# EasyEDA Pro project ProProject_Avaota Pi A_2024-03-25.epro, board PCB1 (continued)
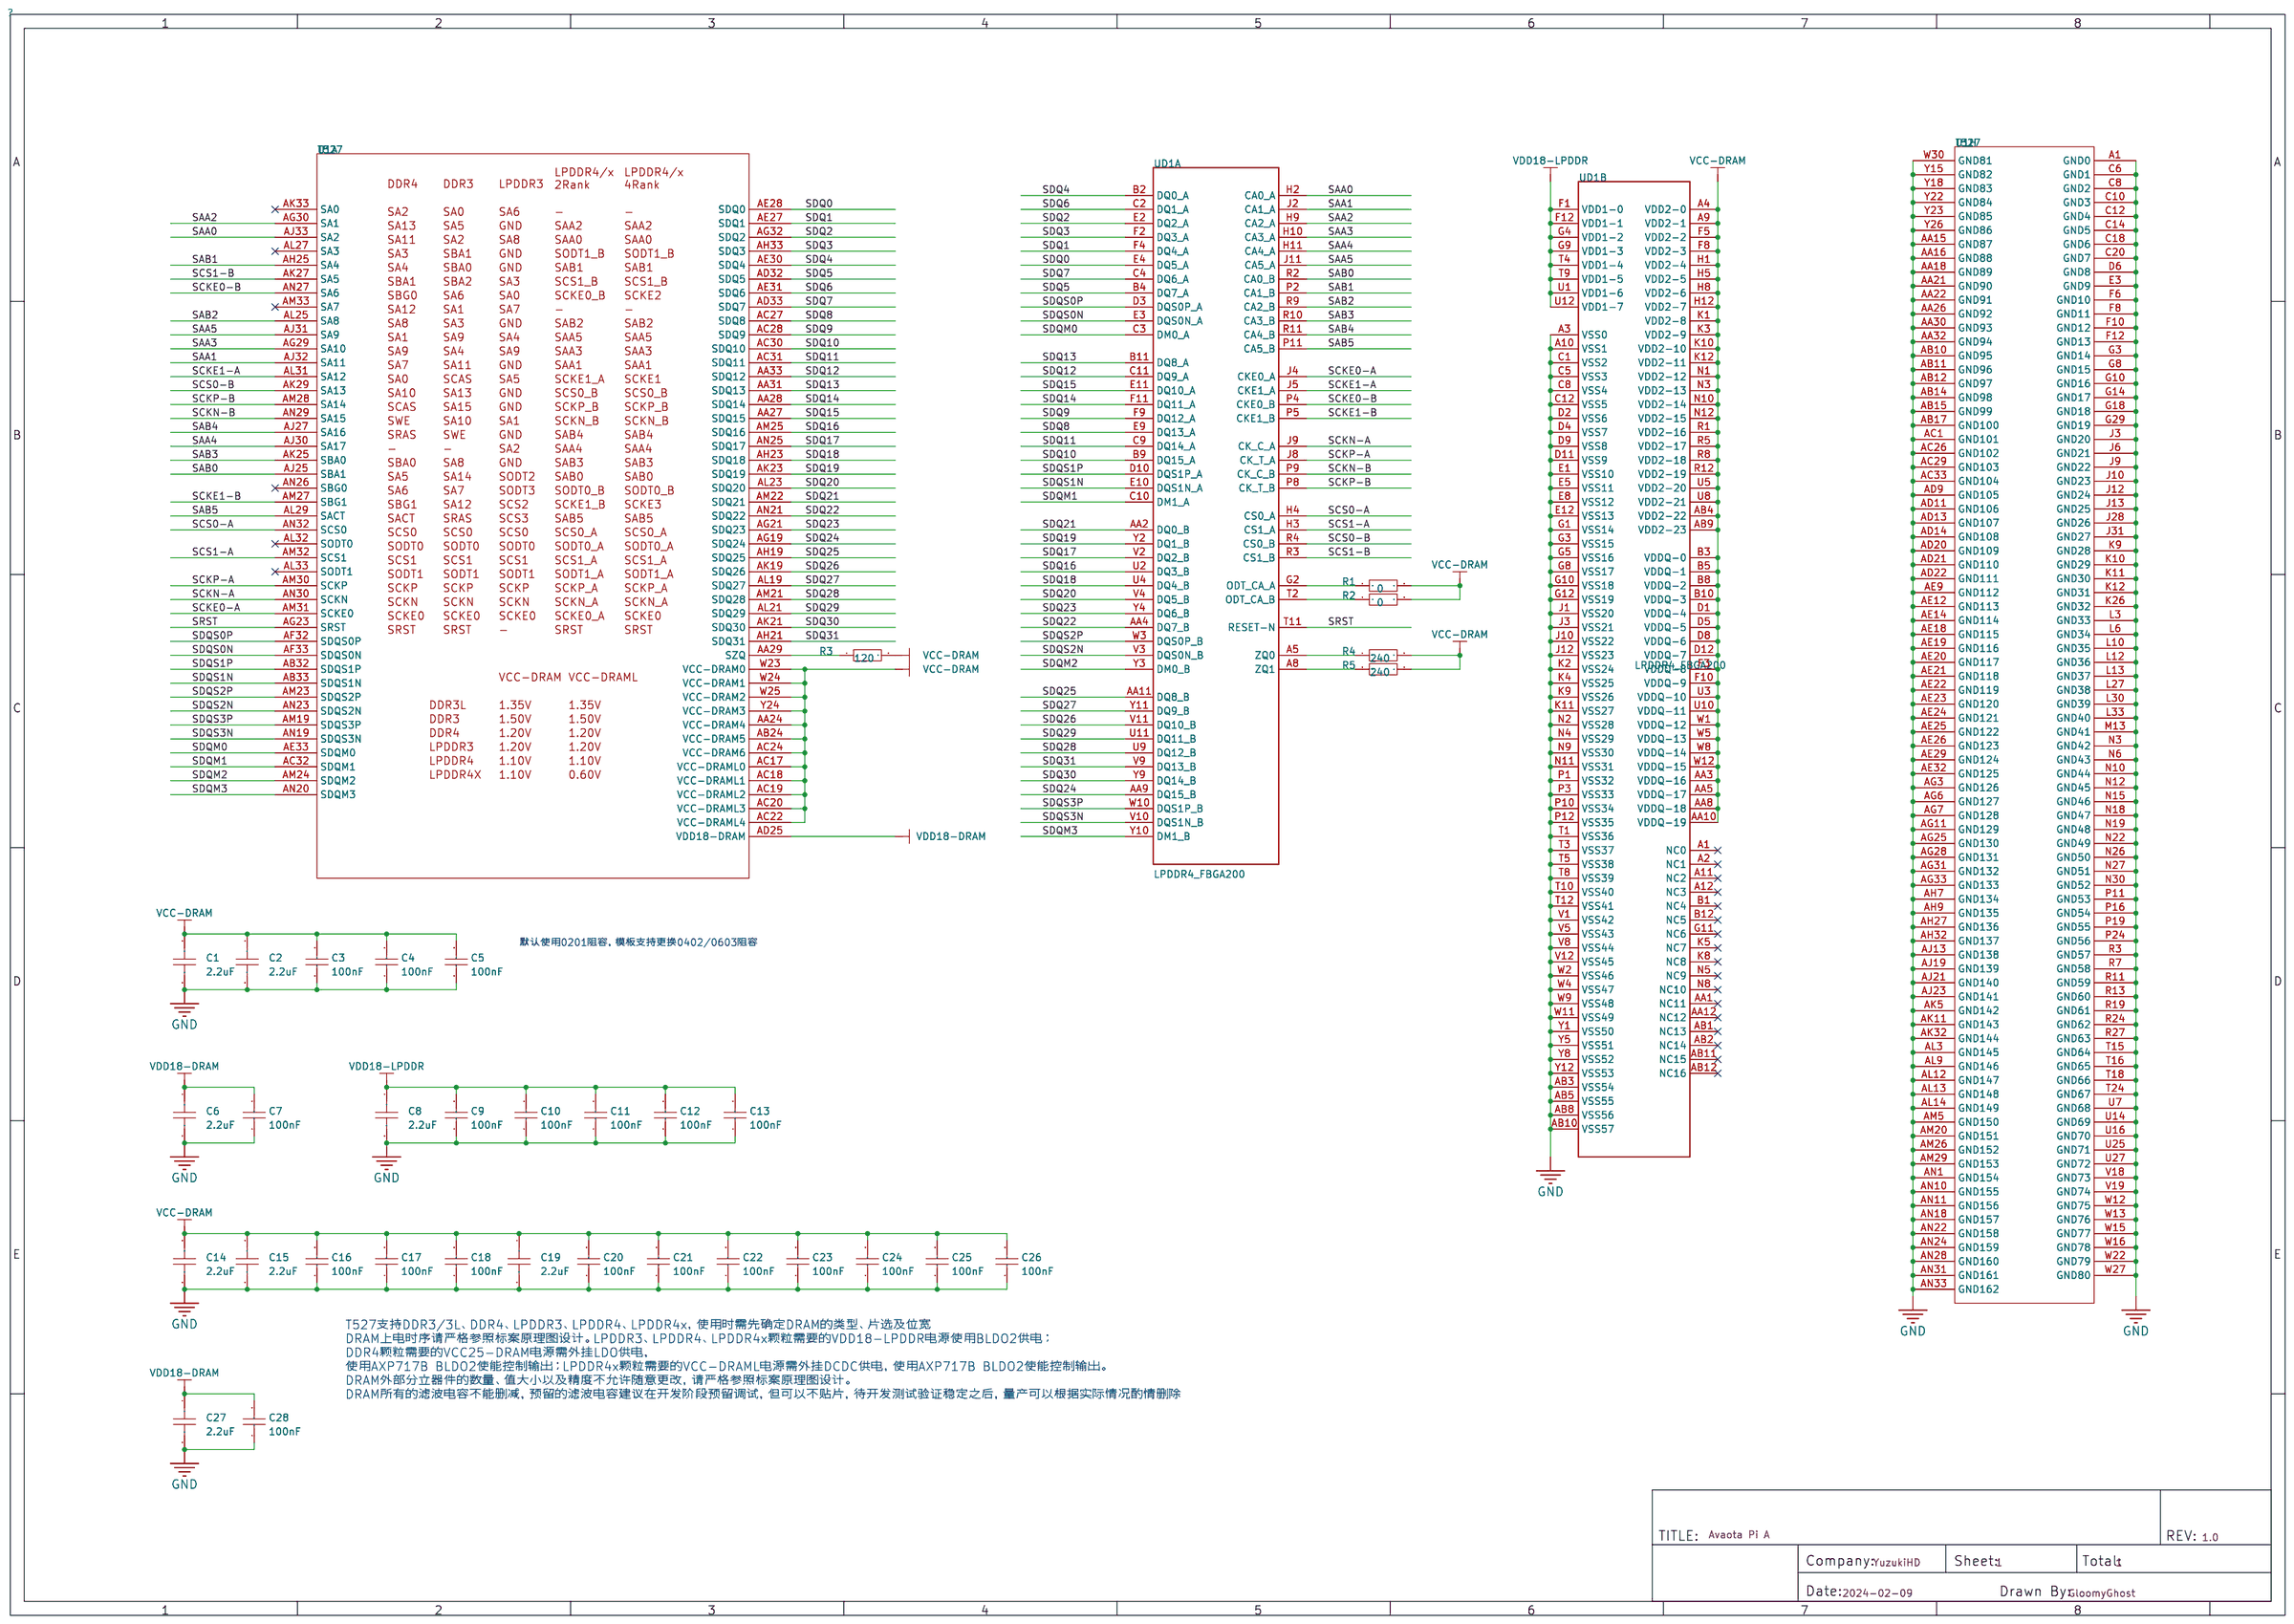
[diagram p0: schematic sheet]
## Routing (per net, layer and track width the routed paths; a pad name or vN(x,y) marks a point on that pad's centre or on a via; arc(x,y) is an arc through that point) (continued)
GM0_MDIP0: length 8.5
  Top Layer w0.127: U12.1 64.8,19.47 64.88,19.38 64.88,18.71 62.59,16.41 62.59,14.59 63.06,14.11 63.06,13.23 RJ1.P2
GM0_MDIP1: length 14.3
  Top Layer w0.127: U12.4 66,19.47 66.08,19.38 66.08,17.34 65.18,16.43 65.18,14.54 66.32,13.39 66.32,12.27 67.06,11.53 67.06,10.97 66.57,10.49 65.63,10.49 65.23,10.9 65.23,12.75 RJ1.P4
GM0_MDIP2: length 7.8
  Top Layer w0.127: RJ1.P5 66.73,15.16 66.73,14.38 66.85,14.25 67.21,14.25 67.63,14.67 67.63,16.22 66.88,16.97 66.88,19.38 66.8,19.47 U12.6
GM0_MDIP3: length 8.5
  Top Layer w0.127: U12.9 68,19.47 68.08,19.38 68.08,19.22 70.15,17.15 70.15,14.76 70.82,14.1 70.82,13.74 70.25,13.18 RJ1.P8
GM0_RSET: length 3.5
  Top Layer w0.127: U12.39 63.23,21.03 63.02,20.82 63.02,20.32 62.26,19.56 61.76,19.56 R85.2
GM0_XTAL_IN: length 4.2
  Top Layer w0.127: U12.36 63.45,22.23 63.3,22.07 C252.2 61.8,21.67 61.06,21.67 60.48,22.25 X3.1
GM0_XTAL_OUT: length 3
  Top Layer w0.127: U12.37 63.59,21.83 63.46,21.7 62.7,21.7 C251.2 61.82,21.21 X3.3
GM1_DVDD10: length 26.2
  Top Layer w0.102: C273.1 80.23,19.91 80.85,19.91 81.15,20.22 81.15,20.7 81.74,21.29 U13.38
  Top Layer w0.127: C272.1 v2(85.78,19.11) 85.78,19.77 U13.8 ; C275.2 83.77,18.72 v2(83.77,19.13) 83.77,19.78 U13.3
  Top Layer w0.152: 86.56,24.79 86.56,25.43 87.68,26.56
  Bottom Layer w0.254: v2(86.69,25.5) arc(86.25,25.08) 85.8,24.66
  Bottom Layer w0.635: 82.8,20.09 84.8,20.09 v2(85.78,19.11) ; 82.8,20.09 v2(83.77,19.13) ; 82.8,20.09 82.45,20.45 ; v2(80.06,26.62) v2(80.06,26.15) 82.45,23.76 ; 82.45,20.45 81.79,20.45 v2(81.31,20.93) ; 82.45,20.45 82.45,23.76 ; 82.45,23.76 83.35,24.66 85.8,24.66
GM1_DVDDRG: length 382.6
  Top Layer w0.102: v2(89.74,21.97) 89.74,21.91 R101.1
  Top Layer w0.127: v1(28.96,22.83) 30.81,22.83 34.66,18.99 R47.1 ; v2(71.96,21.9) 71.91,21.84 R83.1
  Top Layer w0.152: v2(67.31,27.69) 67.31,27.27 67.34,27.24
  Top Layer w0.178: R107.2 85.37,27.48 84.28,28.58 v2(83.85,28.58) ; R109.2 87.07,27.33 87.38,27.64 88.01,27.64 88.34,27.31 88.34,25.88 88.67,25.55 90.09,25.55 90.53,25.12 90.53,24.28 89.74,23.5 v2(89.74,21.97)
  Top Layer w0.203: v2(65.63,26.71) 65.63,25.96 65.6,25.92 U12.28 ; 83.77,26.47 83.67,26.37 83.67,25.93 v2(83.76,25.84) 83.76,24.79 ; v1(12.92,55.07) 12.67,55.07 11.84,54.23 11.58,54.23
  Top Layer w0.254: U8.E6 40.58,33.3 ; 40.58,33.3 U8.J10 U8.K9 ; 40.58,33.3 40.58,33.48 U8.F5 39.6,33.32 v1(39.6,33.17) ; 69.19,27.24 69.19,27.46 69.01,27.64
  VCC w0.254: v2(96.11,51.65) 97.16,52.69 97.16,64.57 97.54,64.95 97.54,67.97 97.05,68.45 95.17,68.45 91.69,71.93 78.54,71.93 76.2,69.6 68.71,69.6 67.13,68.02 63.7,68.02 62.56,66.88 57.8,66.88 v1(56.73,65.81)
  VCC w0.381: v2(58.44,52.15) 57.94,52.65 57.94,53.62 57.4,54.15 57.4,55.56 56.93,56.03 54.18,56.03 53.34,56.87 52.12,56.87 47.52,61.47 29.87,61.47 24.23,55.83 14,55.83 13.23,55.07 v1(12.92,55.07)
  VCC w0.508: v1(12.92,55.07) 11.8,56.18 7.05,56.18 5.36,54.48 5.36,53.24 3.1,50.98 3.1,23.17 6.78,19.48 25.6,19.48 v1(28.96,22.83) 31.85,25.73 37.95,25.73 39.57,27.36 41.15,27.36 ; v2(96.11,51.65) 95.68,51.22 95.68,44.76 90.2,39.27 90.2,38.18 91.54,36.83 91.54,29.57 90.55,28.58 v2(83.85,28.58) 83.44,28.17 v1(82.25,28.17)
  VCC w0.635: v2(67.31,27.69) 67.08,27.46 64.13,27.46 63.65,27.94 59.41,27.86 ; v1(39.6,33.17) 39.6,28.91 41.15,27.36 41.66,27.86 59.41,27.86 ; 59.41,27.86 59.59,27.86
  Inner5 w0.457: 60.45,50.98 61.29,50.14 62.31,50.14 62.46,49.99 63.07,49.99 63.96,49.1 v1(64.44,49.1) ; v2(58.44,52.15) 59.36,51.23 60.12,51.23 60.35,51
  Bottom Layer w0.152: C234.1 C228.1 v1(95.72,46.76) ; v1(39.6,33.17) 40,32.77 C229.2 C235.2
  Bottom Layer w0.254: v1(64.44,49.1) 64.39,49.15 C173.2 C174.2 ; R74.2 66.78,66.19 65.57,67.4 R73.2 65.57,68.16 65.33,68.4 64.57,68.4 63.02,66.85 57.96,66.85 57.38,66.27 ; C230.2 39.4,32.97 v1(39.6,33.17) ; C102.2 58.44,52.15 ; R75.2 v1(56.73,65.81) 57.19,66.27 57.38,66.27 ; v2(65.63,26.71) 65.63,27.2 65.61,27.23 ; 57.38,66.27 57.49,66.27 ; 57.38,66.27 57.28,66.17 ; D20.1 v2(96.11,51.65) 96.11,55.25 96.88,56.01 96.88,57.12 98.56,58.81 SIM1.4
  Bottom Layer w0.381: v2(89.74,21.97) 89.89,22.12 89.89,23.34 89.41,23.83 88.01,23.83 87.27,24.56 87.27,25.78 86.94,26.11 86.28,26.11 86,25.83 83.77,25.83 v2(83.76,25.84)
  Bottom Layer w0.635: 71.91,21.9 69.77,21.9 69.16,22.5 69.16,24.74 70.56,26.14 70.56,27.05 69.93,27.69 ; 69.93,27.69 76.94,27.69 77.42,28.17 v1(82.25,28.17) 83.44,28.17 v2(83.85,28.58) 86.77,28.58 87.88,27.46 87.88,26.39 87.32,25.83 ; 69.93,27.69 v1(69,27.69) v2(67.31,27.69) 66.04,27.69 65.66,27.31
GM1_INTB: length 2.3
  Top Layer w0.102: R106.2 81.23,24.54 81.68,24.09 82.26,24.09
GM1_LED0: length 2.2
  Top Layer w0.102: R110.1 80.16,23.99 R105.2 81.22,23.99 81.52,23.69 U13.32
GM1_LED1: length 27.1
  Top Layer w0.102: 82.26,23.29 v1(81.41,23.29) 81.23,23.47 80.78,23.47 R105.1 80.72,23.48 R102.1
  Top Layer w0.152: R98.2 R112.2 76.65,6.34 76.94,6.63 76.94,7.47 v2(76.3,8.1)
  内层2 w0.152: v1(81.41,23.29) 81.41,22.99 80.95,22.53 80.77,22.53 76.71,18.47 76.71,12.24 75.72,11.25 74.32,11.25 73.43,10.36 73.43,8.99 74.68,7.75 75.95,7.75 v2(76.3,8.1)
GM1_LED2: length 25.4
  Top Layer w0.102: U13.34 81.28,22.89 81.13,23.04 v1(80.82,23.04) 80.2,23.04 R99.1
  Top Layer w0.152: v2(75.64,7.31) 75.54,7.21 75.54,6.5 75.7,6.34 R114.2 R97.1
  内层2 w0.152: v1(80.82,23.04) 76.35,18.57 76.35,12.42 75.56,11.63 74.24,11.63 73.15,10.54 73.15,8.79 74.52,7.42 75.54,7.42 v2(75.64,7.31)
GM1_MDIN0: length 8.7
  Top Layer w0.127: 82.27,15.33 82.45,15.14 82.45,14.38 82.27,14.2 81.64,14.2 81.1,14.73 81.1,16.44 83.27,18.61 83.27,19.24 83.36,19.33 U13.2
GM1_MDIN1: length 14.1
  Top Layer w0.127: 84.43,17.11 83.7,16.38 83.7,14.68 84.85,13.53 84.85,12.44 85.51,11.78 86.55,11.78 86.98,12.21 86.98,14.96 RJ2.P7 ; 84.43,17.11 84.54,17.22 84.54,19.78 U13.5 ; 84.43,17.11 84.5,17.18
GM1_MDIN2: length 7.8
  Top Layer w0.127: RJ2.P6 85.62,13.14 85.62,14.1 86.18,14.66 86.18,16.33 85.3,17.21 85.3,19.2 85.36,19.26 U13.7
GM1_MDIN3: length 8.5
  Top Layer w0.127: U13.10 86.56,19.33 86.47,19.24 86.47,18.53 88.72,16.28 88.72,14.73 89.28,14.17 89.71,14.17 89.92,14.38 89.92,15.3 89.89,15.33
GM1_MDIP0: length 8.5
  Top Layer w0.127: U13.1 82.96,19.33 83.04,19.24 83.04,18.7 80.87,16.54 80.87,14.64 81.56,13.95 81.56,13.44 80.91,12.79 RJ2.P2
GM1_MDIP1: length 14.1
  Top Layer w0.127: RJ2.P4 83.44,11.03 83.93,10.54 84.87,10.54 85.35,11.02 85.35,11.58 84.62,12.31 84.62,13.44 83.47,14.58 83.47,16.48 84.31,17.32 84.31,19.18 84.16,19.33 U13.4 ; 83.53,12.8 83.47,12.85
GM1_MDIP2: length 7.7
  Top Layer w0.127: U13.6 84.96,19.31 85.07,19.2 85.07,17.12 85.95,16.23 85.95,14.76 85.47,14.28 85.14,14.28 84.76,14.66 84.76,15.28 RJ2.P5
GM1_MDIP3: length 8.6
  Top Layer w0.127: U13.9 86.16,19.33 86.24,19.24 86.24,18.44 88.49,16.19 88.49,14.64 89.18,13.95 89.18,13.39 88.58,12.79 RJ2.P8
GM1_RSET: length 3.1
  Top Layer w0.102: U13.39 81.77,20.89 81.46,20.57 81.46,20.09 80.95,19.58 80.57,19.58 80.26,19.28 R103.2
GM1_XTAL_IN: length 3.9
  Top Layer w0.102: C259.2 80.92,21.64 81.23,21.64 81.68,22.09 82.26,22.09
  Top Layer w0.152: X4.1 79.71,21.46 80.39,21.46 C259.2
GM1_XTAL_OUT: length 2.8
  Top Layer w0.102: C257.2 80.75,21.18 80.92,21.36 81.38,21.36 81.71,21.69 U13.37
  Top Layer w0.152: 80.04,20.62 80.37,20.96 C257.2
HBIAS: length 30.4
  Top Layer w0.203: U14.AL1 54.51,56.21 54.51,57.2 v2(54.71,57.4)
  内层2 w0.254: v2(71.78,68.44) 65.06,68.44 v2(63.96,69.55)
  GND2 w0.254: v2(54.71,57.4) 54.86,57.56 54.86,65.76 56.41,67.31 62.38,67.31 63.96,68.89 v2(63.96,69.55)
  Bottom Layer w0.127: v2(71.78,68.44) C237.2 71.04,68.59 R64.2
HCEC: length 49.5
  Top Layer w0.102: U14.E28 v2(67.44,43.15)
  Top Layer w0.127: v2(40.36,23.11) 40.36,22.72 R48.1 38.95,22.7 38.56,22.3 D7.1
  Inner5 w0.127: v2(40.36,23.11) 41.28,24.03 42.11,24.03 42.54,24.46 43.64,24.46 43.97,24.79 44.4,24.79 47.45,27.84 59.31,27.84 60.27,28.8 64.59,28.8 68.12,32.33 68.12,33.99 70.54,36.4 70.54,42.14 70.28,42.39 69.8,42.39 69.42,42.77 67.82,42.77 v2(67.44,43.15)
HHPD: length 44.7
  Top Layer w0.102: v2(67.94,43.15) U14.D28
  Top Layer w0.127: 43.08,23.14 C189.2 ; 43.08,23.14 R54.1 ; 43.08,23.14 44.27,24.33 v2(44.3,24.33)
  Inner5 w0.127: v2(44.3,24.33) 44.6,24.33 47.7,27.43 59.51,27.43 60.48,28.4 64.85,28.4 68.5,32.06 68.5,33.76 70.92,36.17 70.92,42.29 70.43,42.77 69.93,42.77 69.55,43.15 v2(67.94,43.15)
HP-DET: length 25.9
  Top Layer w0.076: 55.46,55.67 55.19,55.95 55.19,56.92 v2(55.07,57.05)
  Top Layer w0.152: CN2.3 68.06,72.41 v2(66.73,71.07)
  GND2 w0.152: v2(55.07,57.05) 55.27,57.25 55.27,65.56 56.67,66.95 62.61,66.95 v2(66.73,71.07)
HPOUTFB: length 42.5
  Top Layer w0.076: 53.62,57.1 53.62,56.64 53.94,56.33 53.94,56.14
  Top Layer w0.254: CN2.6 75.69,63.91 73.81,65.79 73.81,69.47 72.78,70.5 v2(69.89,70.5) 69.89,70.3 69.57,69.98 69.11,69.98 67.74,68.61 63.07,68.61 62.64,69.04 v2(62.64,69.29) ; 53.62,57.1 53.59,57.13 v2(53.59,57.61)
  GND2 w0.254: v2(53.59,57.61) 54,58.01 54,66.37 55.91,68.28 61.62,68.28 v2(62.64,69.29)
  Bottom Layer w0.254: R122.2 R66.2 v2(69.89,70.5) 70.1,70.71 70.45,70.71 C239.1
HPOUTL: length 36.6
  Top Layer w0.076: 54.44,55.64 54.19,55.9 54.19,56.39 54.15,56.43 54.15,56.64
  Top Layer w0.254: CN2.5 74.21,69.81 72.97,71.04 69.22,71.04 v2(68.76,70.59) 68.76,70.18 67.61,69.04 v2(63.35,69.04) ; v2(54.2,57.58) 54.15,57.53 54.15,56.64
  GND2 w0.254: v2(63.35,69.04) 62.15,67.84 56.21,67.84 54.43,66.07 54.43,57.81 v2(54.2,57.58)
  Bottom Layer w0.254: C243.1 68.76,70.16 v2(68.76,70.59)
HPOUTR: length 32.7
  Top Layer w0.076: 53.93,55.68 53.93,55.73 53.7,55.97 53.7,56.29 53.31,56.67 53.31,56.87 53.19,57
  Top Layer w0.254: v2(61.67,69.06) 62.03,69.06 62.92,68.17 67.82,68.17 68.91,67.08 v2(68.91,66.9) 68.91,66.18 CN2.2 ; v2(53.04,57.43) 53.09,57.38 53.09,57.1 53.19,57
  GND2 w0.254: v2(53.04,57.43) 53.04,57.73 53.57,58.27 53.57,66.68 55.65,68.76 61.37,68.76 v2(61.67,69.06)
  Bottom Layer w0.254: 68.14,68.68 68.91,67.91 v2(68.91,66.9)
HREXT: length 1
  Top Layer w0.102: v2(66.94,44.15) U14.F26
  Bottom Layer w0.254: v2(66.94,44.15) 66.91,44.12 R59.2
HS-MIC: length 8.3
  Top Layer w0.254: v2(74.5,72.19) 75.72,73.41 CN2.4
  Bottom Layer w0.127: 70.49,69.57 70.48,69.58
  Bottom Layer w0.254: R64.1 71.04,70.12 71.16,70.12 71.58,70.54 72.85,70.54 v2(74.5,72.19) ; 70.48,70.12 R65.2 ; 70.49,69.57 71.04,69.57
HSCL: length 48.3
  Top Layer w0.102: v2(67.94,44.15) U14.D26
  Top Layer w0.127: R50.1 v2(40.92,23.11)
  Inner5 w0.127: v2(67.94,44.15) 68.09,44.15 68.48,43.76 70.41,43.76 71.22,42.95 71.22,35.97 68.86,33.6 68.86,31.9 64.97,28.02 60.68,28.02 59.74,27.08 47.93,27.08 44.81,23.95 42.72,23.95 42.34,23.57 41.38,23.57 v2(40.92,23.11)
HSDA: length 49
  Top Layer w0.102: U14.E26 v2(67.44,44.15)
  Top Layer w0.127: R51.1 v2(42.01,23.17)
  Inner5 w0.127: v2(67.44,44.15) 67.84,44.55 68.1,44.55 68.5,44.15 70.53,44.15 71.55,43.13 71.55,35.74 69.24,33.43 69.24,31.67 65.23,27.66 60.88,27.66 59.92,26.7 48.01,26.7 44.91,23.6 43.26,23.6 42.82,23.17 v2(42.01,23.17)
HTX0N: length 73.1
  Top Layer w0.076: 68.44,43.14 68.45,43.14 68.58,43.01 arc(68.71,42.92) 68.86,42.89 69.52,42.89 arc(69.56,42.88) 69.59,42.86 69.78,42.67 71.27,42.67 arc(71.7,42.59) 72.06,42.34
  Top Layer w0.102: USB1.9 43.6,10.63 44.04,10.19 44.18,10.19 45.23,11.24 45.23,19.9 45.08,20.05 D6.9 D6.2 45.16,21.4 45.16,22.05 v2(45.03,22.17) ; 72.06,42.32 72.41,41.97 arc(72.75,41.74) 73.15,41.66 74.14,41.63 arc(74.36,41.58) v2(74.52,41.43)
  内层4 w0.102: v2(74.52,41.43) 74.7,41.61 76.33,41.61 77.5,40.44 77.5,30.25 75.56,28.31 71.48,28.31 69.62,30.18 60.22,30.18 58.73,28.68 48.15,28.68 46.43,26.96 46.43,24.08 45.19,22.83 45.19,22.58 45.03,22.43 v2(45.03,22.17)
HTX0P: length 73.1
  Top Layer w0.076: 68.92,43.13 arc(69.06,43.07) 69.21,43.05 69.52,43.05 arc(69.62,43.03) 69.7,42.97 69.82,42.85 arc(69.84,42.85) 69.86,42.85 71.27,42.85 arc(71.77,42.75) 72.19,42.47
  Top Layer w0.102: 72.2,42.47 72.56,42.11 arc(72.83,41.93) 73.15,41.86 74.15,41.84 arc(74.34,41.86) v2(74.52,41.94) ; USB1.7 44,9.93 44.2,9.93 45.43,11.16 45.43,19.9 45.58,20.05 D6.10 D6.1 45.47,21.43 45.47,22.1 v2(45.54,22.17)
  内层4 w0.102: v2(74.52,41.94) 74.65,41.81 76.41,41.81 77.7,40.52 77.7,30.17 75.64,28.11 71.36,28.11 69.49,29.97 60.31,29.97 58.81,28.47 48.23,28.47 46.61,26.85 46.61,24.01 45.39,22.79 45.39,22.58 45.54,22.43 v2(45.54,22.17)
HTX1N: length 77.9
  Top Layer w0.076: 71.78,43.21 70.96,43.21 arc(70.76,43.24) 70.6,43.35 70.52,43.43 arc(70.41,43.51) 70.28,43.53 69.86,43.53 arc(69.72,43.51) 69.6,43.44 arc(69.48,43.39) 69.34,43.4 arc(69.24,43.45) 69.15,43.54 arc(69.05,43.61) 68.93,43.63
  Top Layer w0.102: 42.57,8.86 USB1.6 ; 71.79,43.19 72.42,43.19 arc(72.84,43.12) 73.2,42.9 arc(73.86,42.54) 74.6,42.47 arc(74.78,42.44) v2(74.93,42.34) ; 42.54,8.89 43.84,8.89 44.15,8.59 44.25,8.59 46.61,10.95 46.61,14.98 47.35,15.72 47.35,18.77 46.6,19.52 46.6,19.9 46.45,20.05 D5.6 D5.5 46.53,21.4 46.53,22.07 v2(46.46,22.15)
  内层4 w0.102: v2(74.93,42.34) 75.11,42.52 76.73,42.52 78.36,40.89 78.36,29.87 76,27.51 71.09,27.51 69.32,29.29 60.6,29.29 59.18,27.86 48.66,27.86 47.37,26.58 47.37,26.08 47.24,25.95 47.24,25.7 47.37,25.57 47.37,25.32 47.24,25.19 47.24,24.93 47.37,24.81 47.37,24.55 47.24,24.43 47.24,24.17 47.37,24.05 47.37,23.46 47.13,23.22 46.99,23.22 46.97,23.23 46.83,23.23 46.7,23.11 46.7,22.96 46.72,22.95 46.72,22.8 46.6,22.68 46.6,22.54 46.46,22.4 v2(46.46,22.15)
HTX1P: length 77.9
  Top Layer w0.076: 69.44,43.64 69.48,43.68 arc(69.51,43.7) 69.55,43.71 70.28,43.71 arc(70.48,43.67) 70.64,43.56 70.72,43.48 arc(70.83,43.41) 70.96,43.38 71.78,43.38 arc(71.83,43.39) 71.88,43.4
  Top Layer w0.102: v2(46.96,22.15) 46.84,22.02 46.84,21.43 D5.4 D5.7 46.95,20.05 46.8,19.9 46.8,19.61 47.55,18.86 47.55,15.64 46.81,14.9 46.81,10.86 44.37,8.42 44.37,8.18 43.93,7.73 USB1.4 ; 71.79,43.4 72.42,43.4 arc(72.91,43.31) 73.34,43.05 arc(73.92,42.73) 74.57,42.67 arc(74.77,42.73) v2(74.9,42.88)
  内层4 w0.102: v2(46.96,22.15) 46.96,22.37 46.8,22.54 46.8,22.59 47.57,23.36 47.57,26.49 48.74,27.66 59.27,27.66 60.69,29.08 69.22,29.08 70.99,27.3 76.08,27.3 78.54,29.76 78.54,41.05 76.84,42.75 75.03,42.75 v2(74.9,42.88)
HTX2N: length 82.9
  Top Layer w0.076: 71.82,43.66 71.11,43.66 arc(70.96,43.69) 70.84,43.78 70.83,43.78 arc(70.71,43.87) 70.56,43.89 68.86,43.89 arc(68.7,43.92) 68.57,44.01 68.44,44.14 ; 71.82,43.66 71.96,43.66 ; 71.82,43.66 arc(71.9,43.66) 71.97,43.65
  Top Layer w0.102: 71.97,43.65 72.53,43.65 arc(73.46,43.65) 74.4,43.64 74.88,43.63 arc(75.13,43.57) v2(75.34,43.41) ; USB1.3 43.54,7 43.89,6.66 44.5,6.66 45.42,5.74 46.81,5.74 48.1,7.02 48.1,19.9 47.95,20.05 47.95,21.32 48.06,21.43 48.06,22.05 v2(47.96,22.15)
  内层4 w0.102: v2(75.34,43.41) 75.49,43.56 77.07,43.56 79.17,41.46 79.17,29.39 76.56,26.77 70.77,26.77 69.2,28.35 60.8,28.35 59.63,27.18 49.09,27.18 48.12,26.2 48.12,22.56 47.96,22.4 v2(47.96,22.15)
HTX2P: length 82.9
  Top Layer w0.076: 71.9,43.84 71.98,43.84 arc(71.94,43.84) 71.9,43.84 ; 71.9,43.84 71.11,43.84 arc(71.03,43.86) 70.96,43.9 70.9,43.96 arc(70.78,44.04) 70.64,44.07 69.05,44.07 arc(69.01,44.08) 68.98,44.1 68.94,44.14
  Top Layer w0.102: USB1.1 43.54,6.1 43.89,6.45 44.42,6.45 45.33,5.54 46.9,5.54 48.3,6.94 48.3,19.9 48.45,20.05 D5.10 D5.1 48.34,21.43 48.34,22.01 v2(48.48,22.15) ; 72,43.85 72.53,43.85 arc(73.46,43.85) 74.4,43.84 74.88,43.83 arc(75.11,43.85) v2(75.34,43.92)
  内层4 w0.102: v2(48.48,22.15) 48.48,22.4 48.32,22.56 48.32,26.12 49.17,26.98 59.72,26.98 60.88,28.14 69.11,28.14 70.69,26.57 76.64,26.57 79.38,29.3 79.38,41.5 77.11,43.76 75.49,43.76 v2(75.34,43.92)
HTXCN: length 70.8
  Top Layer w0.076: 68.94,42.64 69.08,42.51 arc(69.2,42.42) 69.35,42.4 69.58,42.4 69.71,42.27 70.75,42.27 arc(70.84,42.27) 70.94,42.27 71.06,42.27 arc(71.2,42.24) 71.32,42.16
  Top Layer w0.102: v2(43.59,22.17) 43.66,22.1 43.66,21.4 D6.5 D6.6 43.58,20.05 43.72,19.9 43.72,19.76 44.5,18.99 44.5,12.29 44.27,12.06 44.17,12.06 43.88,12.36 USB1.12 ; 72.02,41.45 71.32,42.15 71.32,42.16 ; 72.02,41.45 72.03,41.44 ; 72.02,41.45 arc(73.07,40.74) 74.32,40.49 74.85,40.48 arc(75.06,40.43) v2(75.21,40.28)
  内层4 w0.102: v2(43.59,22.17) 43.59,22.43 43.75,22.59 43.75,22.73 43.85,22.82 arc(43.9,22.94) 43.85,23.05 arc(43.8,23.16) 43.85,23.28 43.89,23.32 arc(44.01,23.37) 44.12,23.32 arc(44.23,23.27) 44.34,23.32 45.54,24.52 45.54,27.54 47.49,29.49 57.99,29.49 59.56,31.06 69.98,31.06 71.78,29.26 75.03,29.26 76.68,30.91 76.68,39.73 75.95,40.46 75.39,40.46 v2(75.21,40.28)
HTXCP: length 70.8
  Top Layer w0.076: 69.44,42.64 69.48,42.6 arc(69.52,42.58) 69.55,42.57 69.65,42.57 69.78,42.44 71.06,42.44 arc(71.27,42.41) 71.44,42.3
  Top Layer w0.102: USB1.10 42.57,11.23 43.97,11.23 44.22,11.48 44.22,11.63 44.7,12.12 44.7,19.07 43.93,19.85 43.93,19.9 44.08,20.05 D6.7 D6.4 44.02,21.38 44.02,22.07 v2(44.12,22.17) ; 71.44,42.3 71.46,42.3 72.16,41.59 arc(73.15,40.93) 74.32,40.69 74.85,40.69 arc(75.05,40.73) v2(75.21,40.84)
  内层4 w0.102: v2(75.21,40.84) 75.39,40.67 76.03,40.67 76.89,39.81 76.89,30.83 75.12,29.06 71.65,29.06 69.85,30.86 59.65,30.86 58.07,29.29 47.57,29.29 45.72,27.43 45.72,24.41 43.95,22.64 43.95,22.59 44.12,22.43 v2(44.12,22.17)
IR-RX: length 130.7
  Top Layer w0.076: v1(54.94,48.67) 54.92,48.65 U14.AL16
  Top Layer w0.152: 98.12,16.61 98.12,15.59 97.69,15.16 94.89,15.16 94.08,15.98 v1(94.08,16.1) 94.1,16.12 R124.1
  内层2 w0.102: v1(54.94,48.67) 54.79,48.82 54.07,48.82 51.49,51.4 51.49,54.33 49.68,56.13 46.84,56.13 45.82,57.15 45.36,57.15 v1(44.81,57.71)
  内层4 w0.152: v1(94.08,16.1) 96.06,18.09 97.97,18.09 99.06,19.18 99.06,23.17 95.96,26.26 94.69,26.26 87.63,33.33 87.63,52.04 89.13,53.54 89.13,57.1 86.28,59.94 62.53,59.94 61.14,61.34 57.73,61.34 52.6,66.47 45.19,66.47 v1(43.59,64.87)
  Bottom Layer w0.102: v1(44.81,57.71) 45.21,58.12 45.21,58.85 44.04,60.02 44.04,63.78 43.84,63.98 43.84,64.62 v1(43.59,64.87)
LCD0-CLK: length 74.8
  Top Layer w0.076: 65.3,38.44 65.28,38.94 65.18,39.21 65.2,39.66 65.19,39.95 65.2,40.16 65.2,40.55 65.19,40.78 64.94,41.14
  Top Layer w0.102: 65.3,38.43 65.3,37.54 64.44,36.68 64.36,36.68 62.76,35.08 62.56,35.08 60.81,33.33 55.93,33.33 54.41,31.8 49.3,31.8 43.08,25.58 29.31,25.58 28.68,26.21 27.03,26.21 26.62,25.81 26.62,25.27 27.3,24.59 v2(27.3,23.75)
  Bottom Layer w0.127: FPC1.43 7.23,16.78 9.75,19.3 20.35,19.3 21.59,20.55 22.73,20.55 25.93,23.75 v2(27.3,23.75)
LCD0-D0: length 70
  Top Layer w0.127: v2(63.95,42.65) U14.N28
  内层2 w0.127: v2(63.95,42.65) 63.58,42.27 63.58,41.45 63.75,41.28 64.41,41.28 65.05,40.64 65.05,37.29 62.48,34.72 56.49,34.72 53.64,31.88 37.59,31.88 v2(34.82,34.65)
  Bottom Layer w0.127: FPC1.7 5.56,34.83 34.64,34.83 v2(34.82,34.65)
LCD0-D1: length 69.8
  Top Layer w0.127: U14.N29 v2(63.95,42.15)
  内层2 w0.127: v2(34.82,34.06) 37.39,31.5 53.92,31.5 56.77,34.34 62.61,34.34 65.43,37.16 65.43,40.77 64.05,42.15 v2(63.95,42.15)
  Bottom Layer w0.127: v2(34.82,34.06) 34.39,34.49 11.74,34.49 11.52,34.28 FPC1.8
LCD0-D2: length 70.6
  Top Layer w0.076: v2(68.76,38.13) 68.63,38.25 68.63,39.45 68.19,39.88 68.19,40.4 67.94,40.65
  内层2 w0.127: v2(68.76,38.13) 68.2,38.13 64.01,33.93 57,33.93 54.15,31.09 37.19,31.09 v2(34.85,33.43)
  Bottom Layer w0.127: v2(34.85,33.43) 34.16,34.11 14.05,34.11 13.46,33.53 11.66,33.53 11.41,33.78 FPC1.9
LCD0-D3: length 70.6
  Top Layer w0.076: 67.94,40.15 67.94,39.8 68.4,39.34 v2(68.4,37.72)
  内层2 w0.127: v2(68.4,37.72) 64.24,33.55 57.18,33.55 54.23,30.61 37.06,30.61 v2(34.85,32.82)
  Bottom Layer w0.127: v2(34.85,32.82) 33.93,33.73 14.45,33.73 14.15,33.43 14.15,33.4 13.23,32.49 11.96,32.49 11.17,33.28 FPC1.10
LCD0-D4: length 70.7
  Top Layer w0.127: v2(67.92,41.65) U14.E30
  Bottom Layer w0.127: FPC1.11 10.86,32.78 11.58,32.06 13.59,32.06 14.86,33.33 33.66,33.33 35.89,31.09 42.39,31.09 45.24,33.93 57.23,33.93 61.01,37.72 61.01,39.55 62.43,40.97 64.59,40.97 64.9,40.67 67.32,40.67 67.56,40.91 67.56,41.49 67.72,41.65 v2(67.92,41.65)
LCD0-D5: length 70.6
  Top Layer w0.127: U14.E31 v2(67.92,41.15)
  Bottom Layer w0.127: v2(67.92,41.15) 67.92,40.75 67.46,40.28 64.77,40.28 64.47,40.59 62.66,40.59 61.49,39.42 61.49,37.59 57.38,33.48 45.44,33.48 42.6,30.63 35.69,30.63 33.38,32.94 15.09,32.94 13.77,31.62 11.38,31.62 10.73,32.28 FPC1.12
LCD0-D6: length 71.4
  Top Layer w0.076: 67.44,40.65 67.69,40.41 67.69,39.52 v2(67.94,39.27)
  Bottom Layer w0.127: v2(67.94,39.27) 67.28,39.93 64.62,39.93 64.34,40.21 62.89,40.21 61.9,39.22 61.9,37.39 57.56,33.05 45.72,33.05 42.85,30.18 35.48,30.18 33.12,32.54 15.37,32.54 14.07,31.24 11.02,31.24 10.49,31.78 FPC1.13
LCD0-D7: length 70.6
  Top Layer w0.076: 67.44,40.15 67.44,39.06 v2(67.54,38.96)
  Bottom Layer w0.127: v2(67.54,38.96) 66.9,39.6 64.31,39.6 64.11,39.8 63.02,39.8 62.36,39.14 62.36,37.21 57.78,32.64 45.92,32.64 43.03,29.74 35.31,29.74 32.94,32.11 15.6,32.11 14.33,30.84 10.79,30.84 10.35,31.28 FPC1.14
LCD0-D8: length 67.3
  Top Layer w0.076: 63.94,41.15 64.19,40.9 64.19,40.02 64.08,39.9
  Top Layer w0.102: v2(63.91,39.42) 63.91,39.73 64.08,39.9
  Bottom Layer w0.127: v2(63.91,39.42) 63.2,39.42 62.79,39.01 62.79,37.03 58.01,32.26 46.1,32.26 43.21,29.36 35.15,29.36 32.84,31.67 15.82,31.67 14.6,30.45 10.54,30.45 10.22,30.78 FPC1.15
LCD0-D9: length 66.6
  Top Layer w0.076: 63.94,40.65 63.94,40.12 63.7,39.88
  Top Layer w0.102: 63.7,39.88 63.55,39.73 v2(63.55,38.99)
  Bottom Layer w0.127: FPC1.16 10.06,30.28 10.29,30.05 14.81,30.05 15.98,31.22 32.79,31.22 34.98,29.03 43.43,29.03 46.28,31.88 55.96,31.88 56.01,31.93 58.22,31.93 63.14,36.86 63.14,37.36 63.68,37.9 63.68,38.86 v2(63.55,38.99)
LCD0-D10: length 69.4
  Top Layer w0.076: 66.94,40.65 67.19,40.4 67.19,38.74
  Top Layer w0.102: v2(63.47,34.54) 64.8,34.54 65.15,34.9 65.15,35.31 66.12,36.27 66.95,36.27 67.51,36.83 67.51,38.42 67.19,38.74
  Inner5 w0.127: v2(32.31,30.81) 43.36,30.81 45.9,33.35 61.98,33.35 63.17,34.54 v2(63.47,34.54)
  Bottom Layer w0.127: FPC1.17 9.97,29.78 10.11,29.64 14.99,29.64 16.18,30.84 32.28,30.84 v2(32.31,30.81)
LCD0-D11: length 68.6
  Top Layer w0.076: 66.94,40.15 66.94,38.74
  Top Layer w0.102: 66.94,38.74 66.94,38.6 67.18,38.36 67.18,36.93 66.83,36.58 65.99,36.58 64.82,35.41 64.82,35.15 64.59,34.93 v2(63.93,34.93)
  Inner5 w0.127: v2(63.93,34.93) 63.93,34.49 62.36,32.92 46.1,32.92 43.59,30.4 v2(32.77,30.4)
  Bottom Layer w0.127: FPC1.18 15.21,29.28 16.33,30.4 v2(32.77,30.4)
LCD0-D12: length 70.7
  Top Layer w0.127: v2(66.92,41.65) U14.G30
  Inner5 w0.127: v2(66.92,41.65) 66.77,41.65 66.55,41.43 66.55,40.92 66.7,40.77 66.7,38.74 66.27,38.3 65.76,38.3 65.28,37.82 65.28,36.42 65.51,36.2 65.51,35.56 62.41,32.46 46.3,32.46 43.84,30 v2(33.17,30)
  Bottom Layer w0.127: v2(33.17,30) 16.56,30 15.34,28.78 FPC1.19
LCD0-D13: length 70.5
  Top Layer w0.127: U14.G31 v2(66.92,41.15)
  Inner5 w0.127: v2(66.92,41.15) 67.03,41.04 67.03,38.51 66.37,37.85 65.99,37.85 65.61,37.47 65.61,36.63 65.84,36.4 65.84,35.26 62.64,32.06 46.56,32.06 44.07,29.57 v2(33.55,29.57)
  Bottom Layer w0.127: v2(33.55,29.57) 16.76,29.57 15.48,28.28 FPC1.20
LCD0-D14: length 70.5
  Top Layer w0.076: 66.44,40.65 66.69,40.4 66.69,38.44 66.93,38.2 66.93,37.44 v2(66.83,37.34)
  Inner5 w0.127: v2(66.83,37.34) 66.7,37.47 66.22,37.47 65.94,37.19 65.94,36.8 66.12,36.63 66.12,34.87 62.86,31.62 46.76,31.62 44.3,29.16 v2(34.01,29.16)
  Bottom Layer w0.127: v2(34.01,29.16) 17.04,29.16 15.66,27.78 FPC1.21
LCD0-D15: length 69.7
  Top Layer w0.076: U14.G33 66.5,40.09 66.5,38.38 66.73,38.15 66.73,37.74 66.47,37.49 66.47,37.24 66.4,37.16 66.4,37.11 66.44,37.16
  Inner5 w0.127: v2(34.32,28.7) 44.42,28.7 46.91,31.19 63.12,31.19 66.4,34.47 v2(66.4,36.98)
  Bottom Layer w0.127: FPC1.22 15.82,27.28 17.25,28.7 v2(34.32,28.7)
LCD0-D16: length 66.9
  Top Layer w0.076: 62.94,41.15 63.19,40.9 63.19,40.05 63.2,40.04 63.27,39.76 63.28,39.31 63.21,39.11 63.22,38.83 v2(63.27,38.51)
  Top Layer w0.102: v2(63.27,38.51) 63.2,38.58
  内层4 w0.127: v2(28.88,28.22) 35.31,28.22 39.85,32.77 56.39,32.77 57.07,33.45 60.17,33.45 62,35.28 62,36.53 62.69,37.21 63.17,37.21 63.27,37.31 v2(63.27,38.51)
  Bottom Layer w0.127: v2(28.88,28.22) 17.37,28.22 15.93,26.78 FPC1.23
LCD0-D17: length 90
  Top Layer w0.076: 63.45,37.69 63.14,38 ; 62.94,40.6 63,40.39 63.02,40.29 63.03,40.06 63.02,39.83 63.02,39.83 62.94,39.75 62.94,38.35 63,38.18 63.14,38
  Top Layer w0.102: v2(63.58,36.88) 63.5,36.96 63.5,37.64 63.45,37.69
  内层4 w0.127: v2(29.26,27.81) 35.46,27.81 40.06,32.41 56.51,32.41 57.2,33.1 60.35,33.1 62.36,35.1 62.36,36.27 62.97,36.88 v2(63.58,36.88)
  Inner5 w0.127: 42.39,32.87 45.06,35.53 60.83,35.53 62.18,36.88 v2(63.58,36.88)
  Bottom Layer w0.127: v2(29.26,27.81) 17.65,27.81 16.12,26.28 FPC1.24
LCD0-D18: length 69.5
  Top Layer w0.102: v2(65.94,41.63) 65.94,41.63 U14.H31
  内层4 w0.127: v2(29.59,27.41) 35.59,27.41 40.21,32.03 56.72,32.03 57.4,32.72 60.5,32.72 65.2,37.41 65.2,38.25 65.94,38.99 v2(65.94,41.63)
  Bottom Layer w0.127: FPC1.25 16.3,25.78 17.93,27.41 v2(29.59,27.41)
LCD0-D19: length 75.2
  Top Layer w0.076: 66.12,38.38 66.12,38.56 66.31,38.75 66.31,39.24 66.17,39.39 66.17,40.6 66.09,40.68 65.97,40.68 65.94,40.65
  Top Layer w0.102: v2(64.36,35.38) 64.36,35.43 66.12,37.19 66.12,38.38
  内层4 w0.127: v2(66.85,35.51) 66.73,35.38 v2(64.36,35.38)
  Inner5 w0.127: v2(66.85,35.51) 66.85,34.24 63.35,30.73 47.19,30.73 44.78,28.32 34.85,28.32 33.53,27 v2(29.95,27)
  Bottom Layer w0.127: FPC1.26 16.49,25.28 18.19,26.98 29.92,26.98 v2(29.95,27)
